# EAGLE schematic Resistor_Resistor (EAGLE 8.3.0), part 16 of 43
## Parts (continued)
R21598  10K  RESISTOR_0201  [0201]
R21599  10K  RESISTOR_0201  [0201]
R21600  10K  RESISTOR_0201  [0201]
R21601  10K  RESISTOR_0201  [0201]
R21602  10K  RESISTOR_0201  [0201]
R21603  10K  RESISTOR_0201  [0201]
R21604  10K  RESISTOR_0201  [0201]
R21605  10K  RESISTOR_0201  [0201]
R21606  10K  RESISTOR_0201  [0201]
R21607  10K  RESISTOR_0201  [0201]
R21608  10K  RESISTOR_0201  [0201]
R21609  10K  RESISTOR_0201  [0201]
R21610  10K  RESISTOR_0201  [0201]
R21611  10K  RESISTOR_0201  [0201]
R21612  10K  RESISTOR_0201  [0201]
R21613  10K  RESISTOR_0201  [0201]
R21614  10K  RESISTOR_0201  [0201]
R21615  10K  RESISTOR_0201  [0201]
R21616  10K  RESISTOR_0201  [0201]
R21617  10K  RESISTOR_0201  [0201]
R21618  10K  RESISTOR_0201  [0201]
R21619  10K  RESISTOR_0201  [0201]
R21620  10K  RESISTOR_0201  [0201]
R21621  10K  RESISTOR_0201  [0201]
R21622  10K  RESISTOR_0201  [0201]
R21623  10K  RESISTOR_0201  [0201]
R21624  10K  RESISTOR_0201  [0201]
R21625  10K  RESISTOR_0201  [0201]
R21626  10K  RESISTOR_0201  [0201]
R21627  10K  RESISTOR_0201  [0201]
R21628  10K  RESISTOR_0201  [0201]
R21629  10K  RESISTOR_0201  [0201]
R21630  10K  RESISTOR_0201  [0201]
R21631  10K  RESISTOR_0201  [0201]
R21632  10K  RESISTOR_0201  [0201]
R21633  10K  RESISTOR_0201  [0201]
R21634  10K  RESISTOR_0201  [0201]
R21635  10K  RESISTOR_0201  [0201]
R21636  10K  RESISTOR_0201  [0201]
R21637  10K  RESISTOR_0201  [0201]
R21638  10K  RESISTOR_0201  [0201]
R21639  10K  RESISTOR_0201  [0201]
R21640  10K  RESISTOR_0201  [0201]
R21641  10K  RESISTOR_0201  [0201]
R21642  10K  RESISTOR_0201  [0201]
R21643  10K  RESISTOR_0201  [0201]
R21644  10K  RESISTOR_0201  [0201]
R21645  10K  RESISTOR_0201  [0201]
R21646  10K  RESISTOR_0201  [0201]
R21647  10K  RESISTOR_0201  [0201]
R21648  10K  RESISTOR_0201  [0201]
R21649  10K  RESISTOR_0201  [0201]
R21650  10K  RESISTOR_0201  [0201]
R21651  10K  RESISTOR_0201  [0201]
R21652  10K  RESISTOR_0201  [0201]
R21653  10K  RESISTOR_0201  [0201]
R21654  10K  RESISTOR_0201  [0201]
R21655  10K  RESISTOR_0201  [0201]
R21656  10K  RESISTOR_0201  [0201]
R21657  10K  RESISTOR_0201  [0201]
R21658  10K  RESISTOR_0201  [0201]
R21659  10K  RESISTOR_0201  [0201]
R21660  10K  RESISTOR_0201  [0201]
R21661  10K  RESISTOR_0201  [0201]
R21662  10K  RESISTOR_0201  [0201]
R21663  10K  RESISTOR_0201  [0201]
R21664  10K  RESISTOR_0201  [0201]
R21665  10K  RESISTOR_0201  [0201]
R21666  10K  RESISTOR_0201  [0201]
R21667  10K  RESISTOR_0201  [0201]
R21668  10K  RESISTOR_0201  [0201]
R21669  10K  RESISTOR_0201  [0201]
R21670  10K  RESISTOR_0201  [0201]
R21671  10K  RESISTOR_0201  [0201]
R21672  10K  RESISTOR_0201  [0201]
R21673  10K  RESISTOR_0201  [0201]
R21674  10K  RESISTOR_0201  [0201]
R21675  10K  RESISTOR_0201  [0201]
R21676  10K  RESISTOR_0201  [0201]
R21677  10K  RESISTOR_0201  [0201]
R21678  10K  RESISTOR_0201  [0201]
R21679  10K  RESISTOR_0201  [0201]
R21680  10K  RESISTOR_0201  [0201]
R21681  10K  RESISTOR_0201  [0201]
R21682  10K  RESISTOR_0201  [0201]
R21683  10K  RESISTOR_0201  [0201]
R21684  10K  RESISTOR_0201  [0201]
R21685  10K  RESISTOR_0201  [0201]
R21686  10K  RESISTOR_0201  [0201]
R21687  10K  RESISTOR_0201  [0201]
R21688  10K  RESISTOR_0201  [0201]
R21689  10K  RESISTOR_0201  [0201]
R21690  10K  RESISTOR_0201  [0201]
R21691  10K  RESISTOR_0201  [0201]
R21692  10K  RESISTOR_0201  [0201]
R21693  10K  RESISTOR_0201  [0201]
R21694  10K  RESISTOR_0201  [0201]
R21695  10K  RESISTOR_0201  [0201]
R21696  10K  RESISTOR_0201  [0201]
R21697  10K  RESISTOR_0201  [0201]
R21698  10K  RESISTOR_0201  [0201]
R21699  10K  RESISTOR_0201  [0201]
R21700  10K  RESISTOR_0201  [0201]
R21701  10K  RESISTOR_0201  [0201]
R21702  10K  RESISTOR_0201  [0201]
R21703  10K  RESISTOR_0201  [0201]
R21704  10K  RESISTOR_0201  [0201]
R21705  10K  RESISTOR_0201  [0201]
R21706  10K  RESISTOR_0201  [0201]
R21707  10K  RESISTOR_0201  [0201]
R21708  10K  RESISTOR_0201  [0201]
R21709  10K  RESISTOR_0201  [0201]
R21710  10K  RESISTOR_0201  [0201]
R21711  10K  RESISTOR_0201  [0201]
R21712  10K  RESISTOR_0201  [0201]
R21713  10K  RESISTOR_0201  [0201]
R21714  10K  RESISTOR_0201  [0201]
R21715  10K  RESISTOR_0201  [0201]
R21716  10K  RESISTOR_0201  [0201]
R21717  10K  RESISTOR_0201  [0201]
R21718  10K  RESISTOR_0201  [0201]
R21719  10K  RESISTOR_0201  [0201]
R21720  10K  RESISTOR_0201  [0201]
R21721  10K  RESISTOR_0201  [0201]
R21722  10K  RESISTOR_0201  [0201]
R21723  10K  RESISTOR_0201  [0201]
R21724  10K  RESISTOR_0201  [0201]
R21725  10K  RESISTOR_0201  [0201]
R21726  10K  RESISTOR_0201  [0201]
R21727  10K  RESISTOR_0201  [0201]
R21728  10K  RESISTOR_0201  [0201]
R21729  10K  RESISTOR_0201  [0201]
R21730  10K  RESISTOR_0201  [0201]
R21731  10K  RESISTOR_0201  [0201]
R21732  10K  RESISTOR_0201  [0201]
R21733  10K  RESISTOR_0201  [0201]
R21734  10K  RESISTOR_0201  [0201]
R21735  10K  RESISTOR_0201  [0201]
R21736  10K  RESISTOR_0201  [0201]
R21737  10K  RESISTOR_0201  [0201]
R21738  10K  RESISTOR_0201  [0201]
R21739  10K  RESISTOR_0201  [0201]
R21740  10K  RESISTOR_0201  [0201]
R21741  10K  RESISTOR_0201  [0201]
R21742  10K  RESISTOR_0201  [0201]
R21743  10K  RESISTOR_0201  [0201]
R21744  10K  RESISTOR_0201  [0201]
R21745  10K  RESISTOR_0201  [0201]
R21746  10K  RESISTOR_0201  [0201]
R21747  10K  RESISTOR_0201  [0201]
R21748  10K  RESISTOR_0201  [0201]
R21749  10K  RESISTOR_0201  [0201]
R21750  10K  RESISTOR_0201  [0201]
R21751  10K  RESISTOR_0201  [0201]
R21752  10K  RESISTOR_0201  [0201]
R21753  10K  RESISTOR_0201  [0201]
R21754  10K  RESISTOR_0201  [0201]
R21755  10K  RESISTOR_0201  [0201]
R21756  10K  RESISTOR_0201  [0201]
R21757  10K  RESISTOR_0201  [0201]
R21758  10K  RESISTOR_0201  [0201]
R21759  10K  RESISTOR_0201  [0201]
R21760  10K  RESISTOR_0201  [0201]
R21761  10K  RESISTOR_0201  [0201]
R21762  10K  RESISTOR_0201  [0201]
R21763  10K  RESISTOR_0201  [0201]
R21764  10K  RESISTOR_0201  [0201]
R21765  10K  RESISTOR_0201  [0201]
R21766  10K  RESISTOR_0201  [0201]
R21767  10K  RESISTOR_0201  [0201]
R21768  10K  RESISTOR_0201  [0201]
R21769  10K  RESISTOR_0201  [0201]
R21770  10K  RESISTOR_0201  [0201]
R21771  10K  RESISTOR_0201  [0201]
R21772  10K  RESISTOR_0201  [0201]
R21773  10K  RESISTOR_0201  [0201]
R21774  10K  RESISTOR_0201  [0201]
R21775  10K  RESISTOR_0201  [0201]
R21776  10K  RESISTOR_0201  [0201]
R21777  10K  RESISTOR_0201  [0201]
R21778  10K  RESISTOR_0201  [0201]
R21779  10K  RESISTOR_0201  [0201]
R21780  10K  RESISTOR_0201  [0201]
R21781  10K  RESISTOR_0201  [0201]
R21782  10K  RESISTOR_0201  [0201]
R21783  10K  RESISTOR_0201  [0201]
R21784  10K  RESISTOR_0201  [0201]
R21785  10K  RESISTOR_0201  [0201]
R21786  10K  RESISTOR_0201  [0201]
R21787  10K  RESISTOR_0201  [0201]
R21788  10K  RESISTOR_0201  [0201]
R21789  10K  RESISTOR_0201  [0201]
R21790  10K  RESISTOR_0201  [0201]
R21791  10K  RESISTOR_0201  [0201]
R21792  10K  RESISTOR_0201  [0201]
R21793  10K  RESISTOR_0201  [0201]
R21794  10K  RESISTOR_0201  [0201]
R21795  10K  RESISTOR_0201  [0201]
R21796  10K  RESISTOR_0201  [0201]
R21797  10K  RESISTOR_0201  [0201]
R21798  10K  RESISTOR_0201  [0201]
R21799  10K  RESISTOR_0201  [0201]
R21800  10K  RESISTOR_0201  [0201]
R21801  10K  RESISTOR_0201  [0201]
R21802  10K  RESISTOR_0201  [0201]
R21803  10K  RESISTOR_0201  [0201]
R21804  10K  RESISTOR_0201  [0201]
R21805  10K  RESISTOR_0201  [0201]
R21806  10K  RESISTOR_0201  [0201]
R21807  10K  RESISTOR_0201  [0201]
R21808  10K  RESISTOR_0201  [0201]
R21809  10K  RESISTOR_0201  [0201]
R21810  10K  RESISTOR_0201  [0201]
R21811  10K  RESISTOR_0201  [0201]
R21812  10K  RESISTOR_0201  [0201]
R21813  10K  RESISTOR_0201  [0201]
R21814  10K  RESISTOR_0201  [0201]
R21815  10K  RESISTOR_0201  [0201]
R21816  10K  RESISTOR_0201  [0201]
R21817  10K  RESISTOR_0201  [0201]
R21818  10K  RESISTOR_0201  [0201]
R21819  10K  RESISTOR_0201  [0201]
R21820  10K  RESISTOR_0201  [0201]
R21821  10K  RESISTOR_0201  [0201]
R21822  10K  RESISTOR_0201  [0201]
R21823  10K  RESISTOR_0201  [0201]
R21824  10K  RESISTOR_0201  [0201]
R21825  10K  RESISTOR_0201  [0201]
R21826  10K  RESISTOR_0201  [0201]
R21827  10K  RESISTOR_0201  [0201]
R21828  10K  RESISTOR_0201  [0201]
R21829  10K  RESISTOR_0201  [0201]
R21830  10K  RESISTOR_0201  [0201]
R21831  10K  RESISTOR_0201  [0201]
R21832  10K  RESISTOR_0201  [0201]
R21833  10K  RESISTOR_0201  [0201]
R21834  10K  RESISTOR_0201  [0201]
R21835  10K  RESISTOR_0201  [0201]
R21836  10K  RESISTOR_0201  [0201]
R21837  10K  RESISTOR_0201  [0201]
R21838  10K  RESISTOR_0201  [0201]
R21839  10K  RESISTOR_0201  [0201]
R21840  10K  RESISTOR_0201  [0201]
R21841  10K  RESISTOR_0201  [0201]
R21842  10K  RESISTOR_0201  [0201]
R21843  10K  RESISTOR_0201  [0201]
R21844  10K  RESISTOR_0201  [0201]
R21845  10K  RESISTOR_0201  [0201]
R21846  10K  RESISTOR_0201  [0201]
R21847  10K  RESISTOR_0201  [0201]
R21848  10K  RESISTOR_0201  [0201]
R21849  10K  RESISTOR_0201  [0201]
R21850  10K  RESISTOR_0201  [0201]
R21851  10K  RESISTOR_0201  [0201]
R21852  10K  RESISTOR_0201  [0201]
R21853  10K  RESISTOR_0201  [0201]
R21854  10K  RESISTOR_0201  [0201]
R21855  10K  RESISTOR_0201  [0201]
R21856  10K  RESISTOR_0201  [0201]
R21857  10K  RESISTOR_0201  [0201]
R21858  10K  RESISTOR_0201  [0201]
R21859  10K  RESISTOR_0201  [0201]
R21860  10K  RESISTOR_0201  [0201]
R21861  10K  RESISTOR_0201  [0201]
R21862  10K  RESISTOR_0201  [0201]
R21863  10K  RESISTOR_0201  [0201]
R21864  10K  RESISTOR_0201  [0201]
R21865  10K  RESISTOR_0201  [0201]
R21866  10K  RESISTOR_0201  [0201]
R21867  10K  RESISTOR_0201  [0201]
R21868  10K  RESISTOR_0201  [0201]
R21869  10K  RESISTOR_0201  [0201]
R21870  10K  RESISTOR_0201  [0201]
R21871  10K  RESISTOR_0201  [0201]
R21872  10K  RESISTOR_0201  [0201]
R21873  10K  RESISTOR_0201  [0201]
R21874  10K  RESISTOR_0201  [0201]
R21875  10K  RESISTOR_0201  [0201]
R21876  10K  RESISTOR_0201  [0201]
R21877  10K  RESISTOR_0201  [0201]
R21878  10K  RESISTOR_0201  [0201]
R21879  10K  RESISTOR_0201  [0201]
R21880  10K  RESISTOR_0201  [0201]
R21881  10K  RESISTOR_0201  [0201]
R21882  10K  RESISTOR_0201  [0201]
R21883  10K  RESISTOR_0201  [0201]
R21884  10K  RESISTOR_0201  [0201]
R21885  10K  RESISTOR_0201  [0201]
R21886  10K  RESISTOR_0201  [0201]
R21887  10K  RESISTOR_0201  [0201]
R21888  10K  RESISTOR_0201  [0201]
R21889  10K  RESISTOR_0201  [0201]
R21890  10K  RESISTOR_0201  [0201]
R21891  10K  RESISTOR_0201  [0201]
R21892  10K  RESISTOR_0201  [0201]
R21893  10K  RESISTOR_0201  [0201]
R21894  10K  RESISTOR_0201  [0201]
R21895  10K  RESISTOR_0201  [0201]
R21896  10K  RESISTOR_0201  [0201]
R21897  10K  RESISTOR_0201  [0201]
R21898  10K  RESISTOR_0201  [0201]
R21899  10K  RESISTOR_0201  [0201]
R21900  10K  RESISTOR_0201  [0201]
R21901  10K  RESISTOR_0201  [0201]
R21902  10K  RESISTOR_0201  [0201]
R21903  10K  RESISTOR_0201  [0201]
R21904  10K  RESISTOR_0201  [0201]
R21905  10K  RESISTOR_0201  [0201]
R21906  10K  RESISTOR_0201  [0201]
R21907  10K  RESISTOR_0201  [0201]
R21908  10K  RESISTOR_0201  [0201]
R21909  10K  RESISTOR_0201  [0201]
R21910  10K  RESISTOR_0201  [0201]
R21911  10K  RESISTOR_0201  [0201]
R21912  10K  RESISTOR_0201  [0201]
R21913  10K  RESISTOR_0201  [0201]
R21914  10K  RESISTOR_0201  [0201]
R21915  10K  RESISTOR_0201  [0201]
R21916  10K  RESISTOR_0201  [0201]
R21917  10K  RESISTOR_0201  [0201]
R21918  10K  RESISTOR_0201  [0201]
R21919  10K  RESISTOR_0201  [0201]
R21920  10K  RESISTOR_0201  [0201]
R21921  10K  RESISTOR_0201  [0201]
R21922  10K  RESISTOR_0201  [0201]
R21923  10K  RESISTOR_0201  [0201]
R21924  10K  RESISTOR_0201  [0201]
R21925  10K  RESISTOR_0201  [0201]
R21926  10K  RESISTOR_0201  [0201]
R21927  10K  RESISTOR_0201  [0201]
R21928  10K  RESISTOR_0201  [0201]
R21929  10K  RESISTOR_0201  [0201]
R21930  10K  RESISTOR_0201  [0201]
R21931  10K  RESISTOR_0201  [0201]
R21932  10K  RESISTOR_0201  [0201]
R21933  10K  RESISTOR_0201  [0201]
R21934  10K  RESISTOR_0201  [0201]
R21935  10K  RESISTOR_0201  [0201]
R21936  10K  RESISTOR_0201  [0201]
R21937  10K  RESISTOR_0201  [0201]
R21938  10K  RESISTOR_0201  [0201]
R21939  10K  RESISTOR_0201  [0201]
R21940  10K  RESISTOR_0201  [0201]
R21941  10K  RESISTOR_0201  [0201]
R21942  10K  RESISTOR_0201  [0201]
R21943  10K  RESISTOR_0201  [0201]
R21944  10K  RESISTOR_0201  [0201]
R21945  10K  RESISTOR_0201  [0201]
R21946  10K  RESISTOR_0201  [0201]
R21947  10K  RESISTOR_0201  [0201]
R21948  10K  RESISTOR_0201  [0201]
R21949  10K  RESISTOR_0201  [0201]
R21950  10K  RESISTOR_0201  [0201]
R21951  10K  RESISTOR_0201  [0201]
R21952  10K  RESISTOR_0201  [0201]
R21953  10K  RESISTOR_0201  [0201]
R21954  10K  RESISTOR_0201  [0201]
R21955  10K  RESISTOR_0201  [0201]
R21956  10K  RESISTOR_0201  [0201]
R21957  10K  RESISTOR_0201  [0201]
R21958  10K  RESISTOR_0201  [0201]
R21959  10K  RESISTOR_0201  [0201]
R21960  10K  RESISTOR_0201  [0201]
R21961  10K  RESISTOR_0201  [0201]
R21962  10K  RESISTOR_0201  [0201]
R21963  10K  RESISTOR_0201  [0201]
R21964  10K  RESISTOR_0201  [0201]
R21965  10K  RESISTOR_0201  [0201]
R21966  10K  RESISTOR_0201  [0201]
R21967  10K  RESISTOR_0201  [0201]
R21968  10K  RESISTOR_0201  [0201]
R21969  10K  RESISTOR_0201  [0201]
R21970  10K  RESISTOR_0201  [0201]
R21971  10K  RESISTOR_0201  [0201]
R21972  10K  RESISTOR_0201  [0201]
R21973  10K  RESISTOR_0201  [0201]
R21974  10K  RESISTOR_0201  [0201]
R21975  10K  RESISTOR_0201  [0201]
R21976  10K  RESISTOR_0201  [0201]
R21977  10K  RESISTOR_0201  [0201]
R21978  10K  RESISTOR_0201  [0201]
R21979  10K  RESISTOR_0201  [0201]
R21980  10K  RESISTOR_0201  [0201]
R21981  10K  RESISTOR_0201  [0201]
R21982  10K  RESISTOR_0201  [0201]
R21983  10K  RESISTOR_0201  [0201]
R21984  10K  RESISTOR_0201  [0201]
R21985  10K  RESISTOR_0201  [0201]
R21986  10K  RESISTOR_0201  [0201]
R21987  10K  RESISTOR_0201  [0201]
R21988  10K  RESISTOR_0201  [0201]
R21989  10K  RESISTOR_0201  [0201]
R21990  10K  RESISTOR_0201  [0201]
R21991  10K  RESISTOR_0201  [0201]
R21992  10K  RESISTOR_0201  [0201]
R21993  10K  RESISTOR_0201  [0201]
R21994  10K  RESISTOR_0201  [0201]
R21995  10K  RESISTOR_0201  [0201]
R21996  10K  RESISTOR_0201  [0201]
R21997  10K  RESISTOR_0201  [0201]
R21998  10K  RESISTOR_0201  [0201]
R21999  10K  RESISTOR_0201  [0201]
R22000  10K  RESISTOR_0201  [0201]
R22001  10K  RESISTOR_0201  [0201]
R22002  10K  RESISTOR_0201  [0201]
R22003  10K  RESISTOR_0201  [0201]
R22004  10K  RESISTOR_0201  [0201]
R22005  10K  RESISTOR_0201  [0201]
R22006  10K  RESISTOR_0201  [0201]
R22007  10K  RESISTOR_0201  [0201]
R22008  10K  RESISTOR_0201  [0201]
R22009  10K  RESISTOR_0201  [0201]
R22010  10K  RESISTOR_0201  [0201]
R22011  10K  RESISTOR_0201  [0201]
R22012  10K  RESISTOR_0201  [0201]
R22013  10K  RESISTOR_0201  [0201]
R22014  10K  RESISTOR_0201  [0201]
R22015  10K  RESISTOR_0201  [0201]
R22016  10K  RESISTOR_0201  [0201]
R22017  10K  RESISTOR_0201  [0201]
R22018  10K  RESISTOR_0201  [0201]
R22019  10K  RESISTOR_0201  [0201]
R22020  10K  RESISTOR_0201  [0201]
R22021  10K  RESISTOR_0201  [0201]
R22022  10K  RESISTOR_0201  [0201]
R22023  10K  RESISTOR_0201  [0201]
R22024  10K  RESISTOR_0201  [0201]
R22025  10K  RESISTOR_0201  [0201]
R22026  10K  RESISTOR_0201  [0201]
R22027  10K  RESISTOR_0201  [0201]
R22028  10K  RESISTOR_0201  [0201]
R22029  10K  RESISTOR_0201  [0201]
R22030  10K  RESISTOR_0201  [0201]
R22031  10K  RESISTOR_0201  [0201]
R22032  10K  RESISTOR_0201  [0201]
R22033  10K  RESISTOR_0201  [0201]
R22034  10K  RESISTOR_0201  [0201]
R22035  10K  RESISTOR_0201  [0201]
R22036  10K  RESISTOR_0201  [0201]
R22037  10K  RESISTOR_0201  [0201]
R22038  10K  RESISTOR_0201  [0201]
R22039  10K  RESISTOR_0201  [0201]
R22040  10K  RESISTOR_0201  [0201]
R22041  10K  RESISTOR_0201  [0201]
R22042  10K  RESISTOR_0201  [0201]
R22043  10K  RESISTOR_0201  [0201]
R22044  10K  RESISTOR_0201  [0201]
R22045  10K  RESISTOR_0201  [0201]
R22046  10K  RESISTOR_0201  [0201]
R22047  10K  RESISTOR_0201  [0201]
R22048  10K  RESISTOR_0201  [0201]
R22049  10K  RESISTOR_0201  [0201]
R22050  10K  RESISTOR_0201  [0201]
R22051  10K  RESISTOR_0201  [0201]
R22052  10K  RESISTOR_0201  [0201]
R22053  10K  RESISTOR_0201  [0201]
R22054  10K  RESISTOR_0201  [0201]
R22055  10K  RESISTOR_0201  [0201]
R22056  10K  RESISTOR_0201  [0201]
R22057  10K  RESISTOR_0201  [0201]
R22058  10K  RESISTOR_0201  [0201]
R22059  10K  RESISTOR_0201  [0201]
R22060  10K  RESISTOR_0201  [0201]
R22061  10K  RESISTOR_0201  [0201]
R22062  10K  RESISTOR_0201  [0201]
R22063  10K  RESISTOR_0201  [0201]
R22064  10K  RESISTOR_0201  [0201]
R22065  10K  RESISTOR_0201  [0201]
R22066  10K  RESISTOR_0201  [0201]
R22067  10K  RESISTOR_0201  [0201]
R22068  10K  RESISTOR_0201  [0201]
R22069  10K  RESISTOR_0201  [0201]
R22070  10K  RESISTOR_0201  [0201]
R22071  10K  RESISTOR_0201  [0201]
R22072  10K  RESISTOR_0201  [0201]
R22073  10K  RESISTOR_0201  [0201]
R22074  10K  RESISTOR_0201  [0201]
R22075  10K  RESISTOR_0201  [0201]
R22076  10K  RESISTOR_0201  [0201]
R22077  10K  RESISTOR_0201  [0201]
R22078  10K  RESISTOR_0201  [0201]
R22079  10K  RESISTOR_0201  [0201]
R22080  10K  RESISTOR_0201  [0201]
R22081  10K  RESISTOR_0201  [0201]
R22082  10K  RESISTOR_0201  [0201]
R22083  10K  RESISTOR_0201  [0201]
R22084  10K  RESISTOR_0201  [0201]
R22085  10K  RESISTOR_0201  [0201]
R22086  10K  RESISTOR_0201  [0201]
R22087  10K  RESISTOR_0201  [0201]
R22088  10K  RESISTOR_0201  [0201]
R22089  10K  RESISTOR_0201  [0201]
R22090  10K  RESISTOR_0201  [0201]
R22091  10K  RESISTOR_0201  [0201]
R22092  10K  RESISTOR_0201  [0201]
R22093  10K  RESISTOR_0201  [0201]
R22094  10K  RESISTOR_0201  [0201]
R22095  10K  RESISTOR_0201  [0201]
R22096  10K  RESISTOR_0201  [0201]
R22097  10K  RESISTOR_0201  [0201]
R22098  10K  RESISTOR_0201  [0201]
R22099  10K  RESISTOR_0201  [0201]
R22100  10K  RESISTOR_0201  [0201]
R22101  10K  RESISTOR_0201  [0201]
R22102  10K  RESISTOR_0201  [0201]
R22103  10K  RESISTOR_0201  [0201]
R22104  10K  RESISTOR_0201  [0201]
R22105  10K  RESISTOR_0201  [0201]
R22106  10K  RESISTOR_0201  [0201]
R22107  10K  RESISTOR_0201  [0201]
R22108  10K  RESISTOR_0201  [0201]
R22109  10K  RESISTOR_0201  [0201]
R22110  10K  RESISTOR_0201  [0201]
R22111  10K  RESISTOR_0201  [0201]
R22112  10K  RESISTOR_0201  [0201]
R22113  10K  RESISTOR_0201  [0201]
R22114  10K  RESISTOR_0201  [0201]
R22115  10K  RESISTOR_0201  [0201]
R22116  10K  RESISTOR_0201  [0201]
R22117  10K  RESISTOR_0201  [0201]
R22118  10K  RESISTOR_0201  [0201]
R22119  10K  RESISTOR_0201  [0201]
R22120  10K  RESISTOR_0201  [0201]
R22121  10K  RESISTOR_0201  [0201]
R22122  10K  RESISTOR_0201  [0201]
R22123  10K  RESISTOR_0201  [0201]
R22124  10K  RESISTOR_0201  [0201]
R22125  10K  RESISTOR_0201  [0201]
R22126  10K  RESISTOR_0201  [0201]
R22127  10K  RESISTOR_0201  [0201]
R22128  10K  RESISTOR_0201  [0201]
R22129  10K  RESISTOR_0201  [0201]
R22130  10K  RESISTOR_0201  [0201]
R22131  10K  RESISTOR_0201  [0201]
R22132  10K  RESISTOR_0201  [0201]
R22133  10K  RESISTOR_0201  [0201]
R22134  10K  RESISTOR_0201  [0201]
R22135  10K  RESISTOR_0201  [0201]
R22136  10K  RESISTOR_0201  [0201]
R22137  10K  RESISTOR_0201  [0201]
R22138  10K  RESISTOR_0201  [0201]
R22139  10K  RESISTOR_0201  [0201]
R22140  10K  RESISTOR_0201  [0201]
R22141  10K  RESISTOR_0201  [0201]
R22142  10K  RESISTOR_0201  [0201]
R22143  10K  RESISTOR_0201  [0201]
R22144  10K  RESISTOR_0201  [0201]
R22145  10K  RESISTOR_0201  [0201]
R22146  10K  RESISTOR_0201  [0201]
R22147  10K  RESISTOR_0201  [0201]
R22148  10K  RESISTOR_0201  [0201]
R22149  10K  RESISTOR_0201  [0201]
R22150  10K  RESISTOR_0201  [0201]
R22151  10K  RESISTOR_0201  [0201]
R22152  10K  RESISTOR_0201  [0201]
R22153  10K  RESISTOR_0201  [0201]
R22154  10K  RESISTOR_0201  [0201]
R22155  10K  RESISTOR_0201  [0201]
R22156  10K  RESISTOR_0201  [0201]
R22157  10K  RESISTOR_0201  [0201]
R22158  10K  RESISTOR_0201  [0201]
R22159  10K  RESISTOR_0201  [0201]
R22160  10K  RESISTOR_0201  [0201]
R22161  10K  RESISTOR_0201  [0201]
R22162  10K  RESISTOR_0201  [0201]
R22163  10K  RESISTOR_0201  [0201]
R22164  10K  RESISTOR_0201  [0201]
R22165  10K  RESISTOR_0201  [0201]
R22166  10K  RESISTOR_0201  [0201]
R22167  10K  RESISTOR_0201  [0201]
R22168  10K  RESISTOR_0201  [0201]
R22169  10K  RESISTOR_0201  [0201]
R22170  10K  RESISTOR_0201  [0201]
R22171  10K  RESISTOR_0201  [0201]
R22172  10K  RESISTOR_0201  [0201]
R22173  10K  RESISTOR_0201  [0201]
R22174  10K  RESISTOR_0201  [0201]
R22175  10K  RESISTOR_0201  [0201]
R22176  10K  RESISTOR_0201  [0201]
R22177  10K  RESISTOR_0201  [0201]
R22178  10K  RESISTOR_0201  [0201]
R22179  10K  RESISTOR_0201  [0201]
R22180  10K  RESISTOR_0201  [0201]
R22181  10K  RESISTOR_0201  [0201]
R22182  10K  RESISTOR_0201  [0201]
R22183  10K  RESISTOR_0201  [0201]
R22184  10K  RESISTOR_0201  [0201]
R22185  10K  RESISTOR_0201  [0201]
R22186  10K  RESISTOR_0201  [0201]
R22187  10K  RESISTOR_0201  [0201]
R22188  10K  RESISTOR_0201  [0201]
R22189  10K  RESISTOR_0201  [0201]
R22190  10K  RESISTOR_0201  [0201]
R22191  10K  RESISTOR_0201  [0201]
R22192  10K  RESISTOR_0201  [0201]
R22193  10K  RESISTOR_0201  [0201]
R22194  10K  RESISTOR_0201  [0201]
R22195  10K  RESISTOR_0201  [0201]
R22196  10K  RESISTOR_0201  [0201]
R22197  10K  RESISTOR_0201  [0201]
R22198  10K  RESISTOR_0201  [0201]
R22199  10K  RESISTOR_0201  [0201]
R22200  10K  RESISTOR_0201  [0201]
R22201  10K  RESISTOR_0201  [0201]
R22202  10K  RESISTOR_0201  [0201]
R22203  10K  RESISTOR_0201  [0201]
R22204  10K  RESISTOR_0201  [0201]
R22205  10K  RESISTOR_0201  [0201]
R22206  10K  RESISTOR_0201  [0201]
R22207  10K  RESISTOR_0201  [0201]
R22208  10K  RESISTOR_0201  [0201]
R22209  10K  RESISTOR_0201  [0201]
R22210  10K  RESISTOR_0201  [0201]
R22211  10K  RESISTOR_0201  [0201]
R22212  10K  RESISTOR_0201  [0201]
R22213  10K  RESISTOR_0201  [0201]
R22214  10K  RESISTOR_0201  [0201]
R22215  10K  RESISTOR_0201  [0201]
R22216  10K  RESISTOR_0201  [0201]
R22217  10K  RESISTOR_0201  [0201]
R22218  10K  RESISTOR_0201  [0201]
R22219  10K  RESISTOR_0201  [0201]
R22220  10K  RESISTOR_0201  [0201]
R22221  10K  RESISTOR_0201  [0201]
R22222  10K  RESISTOR_0201  [0201]
R22223  10K  RESISTOR_0201  [0201]
R22224  10K  RESISTOR_0201  [0201]
R22225  10K  RESISTOR_0201  [0201]
R22226  10K  RESISTOR_0201  [0201]
R22227  10K  RESISTOR_0201  [0201]
R22228  10K  RESISTOR_0201  [0201]
R22229  10K  RESISTOR_0201  [0201]
R22230  10K  RESISTOR_0201  [0201]
R22231  10K  RESISTOR_0201  [0201]
R22232  10K  RESISTOR_0201  [0201]
R22233  10K  RESISTOR_0201  [0201]
R22234  10K  RESISTOR_0201  [0201]
R22235  10K  RESISTOR_0201  [0201]
R22236  10K  RESISTOR_0201  [0201]
R22237  10K  RESISTOR_0201  [0201]
R22238  10K  RESISTOR_0201  [0201]
R22239  10K  RESISTOR_0201  [0201]
R22240  10K  RESISTOR_0201  [0201]
R22241  10K  RESISTOR_0201  [0201]
R22242  10K  RESISTOR_0201  [0201]
R22243  10K  RESISTOR_0201  [0201]
R22244  10K  RESISTOR_0201  [0201]
R22245  10K  RESISTOR_0201  [0201]
R22246  10K  RESISTOR_0201  [0201]
R22247  10K  RESISTOR_0201  [0201]
R22248  10K  RESISTOR_0201  [0201]
R22249  10K  RESISTOR_0201  [0201]
R22250  10K  RESISTOR_0201  [0201]
R22251  10K  RESISTOR_0201  [0201]
R22252  10K  RESISTOR_0201  [0201]
R22253  10K  RESISTOR_0201  [0201]
R22254  10K  RESISTOR_0201  [0201]
R22255  10K  RESISTOR_0201  [0201]
R22256  10K  RESISTOR_0201  [0201]
R22257  10K  RESISTOR_0201  [0201]
R22258  10K  RESISTOR_0201  [0201]
R22259  10K  RESISTOR_0201  [0201]
R22260  10K  RESISTOR_0201  [0201]
R22261  10K  RESISTOR_0201  [0201]
R22262  10K  RESISTOR_0201  [0201]
R22263  10K  RESISTOR_0201  [0201]
R22264  10K  RESISTOR_0201  [0201]
R22265  10K  RESISTOR_0201  [0201]
R22266  10K  RESISTOR_0201  [0201]
R22267  10K  RESISTOR_0201  [0201]
R22268  10K  RESISTOR_0201  [0201]
R22269  10K  RESISTOR_0201  [0201]
R22270  10K  RESISTOR_0201  [0201]
R22271  10K  RESISTOR_0201  [0201]
R22272  10K  RESISTOR_0201  [0201]
R22273  10K  RESISTOR_0201  [0201]
R22274  10K  RESISTOR_0201  [0201]
R22275  10K  RESISTOR_0201  [0201]
R22276  10K  RESISTOR_0201  [0201]
R22277  10K  RESISTOR_0201  [0201]
R22278  10K  RESISTOR_0201  [0201]
R22279  10K  RESISTOR_0201  [0201]
R22280  10K  RESISTOR_0201  [0201]
R22281  10K  RESISTOR_0201  [0201]
R22282  10K  RESISTOR_0201  [0201]
R22283  10K  RESISTOR_0201  [0201]
R22284  10K  RESISTOR_0201  [0201]
R22285  10K  RESISTOR_0201  [0201]
R22286  10K  RESISTOR_0201  [0201]
R22287  10K  RESISTOR_0201  [0201]
R22288  10K  RESISTOR_0201  [0201]
R22289  10K  RESISTOR_0201  [0201]
R22290  10K  RESISTOR_0201  [0201]
R22291  10K  RESISTOR_0201  [0201]
R22292  10K  RESISTOR_0201  [0201]
R22293  10K  RESISTOR_0201  [0201]
R22294  10K  RESISTOR_0201  [0201]
R22295  10K  RESISTOR_0201  [0201]
R22296  10K  RESISTOR_0201  [0201]
R22297  10K  RESISTOR_0201  [0201]
R22298  10K  RESISTOR_0201  [0201]
R22299  10K  RESISTOR_0201  [0201]
R22300  10K  RESISTOR_0201  [0201]
R22301  10K  RESISTOR_0201  [0201]
R22302  10K  RESISTOR_0201  [0201]
R22303  10K  RESISTOR_0201  [0201]
R22304  10K  RESISTOR_0201  [0201]
R22305  10K  RESISTOR_0201  [0201]
R22306  10K  RESISTOR_0201  [0201]
R22307  10K  RESISTOR_0201  [0201]
R22308  10K  RESISTOR_0201  [0201]
R22309  10K  RESISTOR_0201  [0201]
R22310  10K  RESISTOR_0201  [0201]
R22311  10K  RESISTOR_0201  [0201]
R22312  10K  RESISTOR_0201  [0201]
R22313  10K  RESISTOR_0201  [0201]
R22314  10K  RESISTOR_0201  [0201]
R22315  10K  RESISTOR_0201  [0201]
R22316  10K  RESISTOR_0201  [0201]
R22317  10K  RESISTOR_0201  [0201]
R22318  10K  RESISTOR_0201  [0201]
R22319  10K  RESISTOR_0201  [0201]
R22320  10K  RESISTOR_0201  [0201]
R22321  10K  RESISTOR_0201  [0201]
R22322  10K  RESISTOR_0201  [0201]
R22323  10K  RESISTOR_0201  [0201]
R22324  10K  RESISTOR_0201  [0201]
R22325  10K  RESISTOR_0201  [0201]
R22326  10K  RESISTOR_0201  [0201]
R22327  10K  RESISTOR_0201  [0201]
R22328  10K  RESISTOR_0201  [0201]
R22329  10K  RESISTOR_0201  [0201]
R22330  10K  RESISTOR_0201  [0201]
R22331  10K  RESISTOR_0201  [0201]
R22332  10K  RESISTOR_0201  [0201]
R22333  10K  RESISTOR_0201  [0201]
R22334  10K  RESISTOR_0201  [0201]
R22335  10K  RESISTOR_0201  [0201]
R22336  10K  RESISTOR_0201  [0201]
R22337  10K  RESISTOR_0201  [0201]
R22338  10K  RESISTOR_0201  [0201]
R22339  10K  RESISTOR_0201  [0201]
R22340  10K  RESISTOR_0201  [0201]
R22341  10K  RESISTOR_0201  [0201]
R22342  10K  RESISTOR_0201  [0201]
R22343  10K  RESISTOR_0201  [0201]
R22344  10K  RESISTOR_0201  [0201]
R22345  10K  RESISTOR_0201  [0201]
R22346  10K  RESISTOR_0201  [0201]
R22347  10K  RESISTOR_0201  [0201]
R22348  10K  RESISTOR_0201  [0201]
R22349  10K  RESISTOR_0201  [0201]
R22350  10K  RESISTOR_0201  [0201]
R22351  10K  RESISTOR_0201  [0201]
R22352  10K  RESISTOR_0201  [0201]
R22353  10K  RESISTOR_0201  [0201]
R22354  10K  RESISTOR_0201  [0201]
R22355  10K  RESISTOR_0201  [0201]
R22356  10K  RESISTOR_0201  [0201]
R22357  10K  RESISTOR_0201  [0201]
R22358  10K  RESISTOR_0201  [0201]
R22359  10K  RESISTOR_0201  [0201]
R22360  10K  RESISTOR_0201  [0201]
R22361  10K  RESISTOR_0201  [0201]
R22362  10K  RESISTOR_0201  [0201]
R22363  10K  RESISTOR_0201  [0201]
R22364  10K  RESISTOR_0201  [0201]
R22365  10K  RESISTOR_0201  [0201]
R22366  10K  RESISTOR_0201  [0201]
R22367  10K  RESISTOR_0201  [0201]
R22368  10K  RESISTOR_0201  [0201]
R22369  10K  RESISTOR_0201  [0201]
R22370  10K  RESISTOR_0201  [0201]
R22371  10K  RESISTOR_0201  [0201]
R22372  10K  RESISTOR_0201  [0201]
R22373  10K  RESISTOR_0201  [0201]
R22374  10K  RESISTOR_0201  [0201]
R22375  10K  RESISTOR_0201  [0201]
R22376  10K  RESISTOR_0201  [0201]
R22377  10K  RESISTOR_0201  [0201]
R22378  10K  RESISTOR_0201  [0201]
R22379  10K  RESISTOR_0201  [0201]
R22380  10K  RESISTOR_0201  [0201]
R22381  10K  RESISTOR_0201  [0201]
R22382  10K  RESISTOR_0201  [0201]
R22383  10K  RESISTOR_0201  [0201]
R22384  10K  RESISTOR_0201  [0201]
R22385  10K  RESISTOR_0201  [0201]
R22386  10K  RESISTOR_0201  [0201]
R22387  10K  RESISTOR_0201  [0201]
R22388  10K  RESISTOR_0201  [0201]
R22389  10K  RESISTOR_0201  [0201]
R22390  10K  RESISTOR_0201  [0201]
R22391  10K  RESISTOR_0201  [0201]
R22392  10K  RESISTOR_0201  [0201]
R22393  10K  RESISTOR_0201  [0201]
R22394  10K  RESISTOR_0201  [0201]
R22395  10K  RESISTOR_0201  [0201]
R22396  10K  RESISTOR_0201  [0201]
R22397  10K  RESISTOR_0201  [0201]
R22398  10K  RESISTOR_0201  [0201]
R22399  10K  RESISTOR_0201  [0201]
R22400  10K  RESISTOR_0201  [0201]
R22401  10K  RESISTOR_0201  [0201]
R22402  10K  RESISTOR_0201  [0201]
R22403  10K  RESISTOR_0201  [0201]
R22404  10K  RESISTOR_0201  [0201]
R22405  10K  RESISTOR_0201  [0201]
R22406  10K  RESISTOR_0201  [0201]
R22407  10K  RESISTOR_0201  [0201]
R22408  10K  RESISTOR_0201  [0201]
R22409  10K  RESISTOR_0201  [0201]
R22410  10K  RESISTOR_0201  [0201]
R22411  10K  RESISTOR_0201  [0201]
R22412  10K  RESISTOR_0201  [0201]
R22413  10K  RESISTOR_0201  [0201]
R22414  10K  RESISTOR_0201  [0201]
R22415  10K  RESISTOR_0201  [0201]
R22416  10K  RESISTOR_0201  [0201]
R22417  10K  RESISTOR_0201  [0201]
R22418  10K  RESISTOR_0201  [0201]
R22419  10K  RESISTOR_0201  [0201]
R22420  10K  RESISTOR_0201  [0201]
R22421  10K  RESISTOR_0201  [0201]
R22422  10K  RESISTOR_0201  [0201]
R22423  10K  RESISTOR_0201  [0201]
R22424  10K  RESISTOR_0201  [0201]
R22425  10K  RESISTOR_0201  [0201]
R22426  10K  RESISTOR_0201  [0201]
R22427  10K  RESISTOR_0201  [0201]
R22428  10K  RESISTOR_0201  [0201]
R22429  10K  RESISTOR_0201  [0201]
R22430  10K  RESISTOR_0201  [0201]
R22431  10K  RESISTOR_0201  [0201]
R22432  10K  RESISTOR_0201  [0201]
R22433  10K  RESISTOR_0201  [0201]
R22434  10K  RESISTOR_0201  [0201]
R22435  10K  RESISTOR_0201  [0201]
R22436  10K  RESISTOR_0201  [0201]
R22437  10K  RESISTOR_0201  [0201]
R22438  10K  RESISTOR_0201  [0201]
R22439  10K  RESISTOR_0201  [0201]
R22440  10K  RESISTOR_0201  [0201]
R22441  10K  RESISTOR_0201  [0201]
R22442  10K  RESISTOR_0201  [0201]
R22443  10K  RESISTOR_0201  [0201]
R22444  10K  RESISTOR_0201  [0201]
R22445  10K  RESISTOR_0201  [0201]
R22446  10K  RESISTOR_0201  [0201]
R22447  10K  RESISTOR_0201  [0201]
R22448  10K  RESISTOR_0201  [0201]
R22449  10K  RESISTOR_0201  [0201]
R22450  10K  RESISTOR_0201  [0201]
R22451  10K  RESISTOR_0201  [0201]
R22452  10K  RESISTOR_0201  [0201]
R22453  10K  RESISTOR_0201  [0201]
R22454  10K  RESISTOR_0201  [0201]
R22455  10K  RESISTOR_0201  [0201]
R22456  10K  RESISTOR_0201  [0201]
R22457  10K  RESISTOR_0201  [0201]
R22458  10K  RESISTOR_0201  [0201]
R22459  10K  RESISTOR_0201  [0201]
R22460  10K  RESISTOR_0201  [0201]
R22461  10K  RESISTOR_0201  [0201]
R22462  10K  RESISTOR_0201  [0201]
R22463  10K  RESISTOR_0201  [0201]
R22464  10K  RESISTOR_0201  [0201]
R22465  10K  RESISTOR_0201  [0201]
R22466  10K  RESISTOR_0201  [0201]
R22467  10K  RESISTOR_0201  [0201]
R22468  10K  RESISTOR_0201  [0201]
R22469  10K  RESISTOR_0201  [0201]
R22470  10K  RESISTOR_0201  [0201]
R22471  10K  RESISTOR_0201  [0201]
R22472  10K  RESISTOR_0201  [0201]
R22473  10K  RESISTOR_0201  [0201]
R22474  10K  RESISTOR_0201  [0201]
R22475  10K  RESISTOR_0201  [0201]
R22476  10K  RESISTOR_0201  [0201]
R22477  10K  RESISTOR_0201  [0201]
R22478  10K  RESISTOR_0201  [0201]
R22479  10K  RESISTOR_0201  [0201]
R22480  10K  RESISTOR_0201  [0201]
R22481  10K  RESISTOR_0201  [0201]
R22482  10K  RESISTOR_0201  [0201]
R22483  10K  RESISTOR_0201  [0201]
R22484  10K  RESISTOR_0201  [0201]
R22485  10K  RESISTOR_0201  [0201]
R22486  10K  RESISTOR_0201  [0201]
R22487  10K  RESISTOR_0201  [0201]
R22488  10K  RESISTOR_0201  [0201]
R22489  10K  RESISTOR_0201  [0201]
R22490  10K  RESISTOR_0201  [0201]
R22491  10K  RESISTOR_0201  [0201]
R22492  10K  RESISTOR_0201  [0201]
R22493  10K  RESISTOR_0201  [0201]
R22494  10K  RESISTOR_0201  [0201]
R22495  10K  RESISTOR_0201  [0201]
R22496  10K  RESISTOR_0201  [0201]
R22497  10K  RESISTOR_0201  [0201]
R22498  10K  RESISTOR_0201  [0201]
R22499  10K  RESISTOR_0201  [0201]
R22500  10K  RESISTOR_0201  [0201]
R22501  10K  RESISTOR_0201  [0201]
R22502  10K  RESISTOR_0201  [0201]
R22503  10K  RESISTOR_0201  [0201]
R22504  10K  RESISTOR_0201  [0201]
R22505  10K  RESISTOR_0201  [0201]
R22506  10K  RESISTOR_0201  [0201]
R22507  10K  RESISTOR_0201  [0201]
R22508  10K  RESISTOR_0201  [0201]
R22509  10K  RESISTOR_0201  [0201]
R22510  10K  RESISTOR_0201  [0201]
R22511  10K  RESISTOR_0201  [0201]
R22512  10K  RESISTOR_0201  [0201]
R22513  10K  RESISTOR_0201  [0201]
R22514  10K  RESISTOR_0201  [0201]
R22515  10K  RESISTOR_0201  [0201]
R22516  10K  RESISTOR_0201  [0201]
R22517  10K  RESISTOR_0201  [0201]
R22518  10K  RESISTOR_0201  [0201]
R22519  10K  RESISTOR_0201  [0201]
R22520  10K  RESISTOR_0201  [0201]
R22521  10K  RESISTOR_0201  [0201]
R22522  10K  RESISTOR_0201  [0201]
R22523  10K  RESISTOR_0201  [0201]
R22524  10K  RESISTOR_0201  [0201]
R22525  10K  RESISTOR_0201  [0201]
R22526  10K  RESISTOR_0201  [0201]
R22527  10K  RESISTOR_0201  [0201]
R22528  10K  RESISTOR_0201  [0201]
R22529  10K  RESISTOR_0201  [0201]
R22530  10K  RESISTOR_0201  [0201]
R22531  10K  RESISTOR_0201  [0201]
R22532  10K  RESISTOR_0201  [0201]
R22533  10K  RESISTOR_0201  [0201]
R22534  10K  RESISTOR_0201  [0201]
R22535  10K  RESISTOR_0201  [0201]
R22536  10K  RESISTOR_0201  [0201]
R22537  10K  RESISTOR_0201  [0201]
R22538  10K  RESISTOR_0201  [0201]
R22539  10K  RESISTOR_0201  [0201]
R22540  10K  RESISTOR_0201  [0201]
R22541  10K  RESISTOR_0201  [0201]
R22542  10K  RESISTOR_0201  [0201]
R22543  10K  RESISTOR_0201  [0201]
R22544  10K  RESISTOR_0201  [0201]
R22545  10K  RESISTOR_0201  [0201]
R22546  10K  RESISTOR_0201  [0201]
R22547  10K  RESISTOR_0201  [0201]
R22548  10K  RESISTOR_0201  [0201]
R22549  10K  RESISTOR_0201  [0201]
R22550  10K  RESISTOR_0201  [0201]
R22551  10K  RESISTOR_0201  [0201]
R22552  10K  RESISTOR_0201  [0201]
R22553  10K  RESISTOR_0201  [0201]
R22554  10K  RESISTOR_0201  [0201]
R22555  10K  RESISTOR_0201  [0201]
R22556  10K  RESISTOR_0201  [0201]
R22557  10K  RESISTOR_0201  [0201]
R22558  10K  RESISTOR_0201  [0201]
R22559  10K  RESISTOR_0201  [0201]
R22560  10K  RESISTOR_0201  [0201]
R22561  10K  RESISTOR_0201  [0201]
R22562  10K  RESISTOR_0201  [0201]
R22563  10K  RESISTOR_0201  [0201]
R22564  10K  RESISTOR_0201  [0201]
R22565  10K  RESISTOR_0201  [0201]
R22566  10K  RESISTOR_0201  [0201]
R22567  10K  RESISTOR_0201  [0201]
R22568  10K  RESISTOR_0201  [0201]
R22569  10K  RESISTOR_0201  [0201]
R22570  10K  RESISTOR_0201  [0201]
R22571  10K  RESISTOR_0201  [0201]
R22572  10K  RESISTOR_0201  [0201]
R22573  10K  RESISTOR_0201  [0201]
R22574  10K  RESISTOR_0201  [0201]
R22575  10K  RESISTOR_0201  [0201]
R22576  10K  RESISTOR_0201  [0201]
R22577  10K  RESISTOR_0201  [0201]
R22578  10K  RESISTOR_0201  [0201]
R22579  10K  RESISTOR_0201  [0201]
R22580  10K  RESISTOR_0201  [0201]
R22581  10K  RESISTOR_0201  [0201]
R22582  10K  RESISTOR_0201  [0201]
R22583  10K  RESISTOR_0201  [0201]
R22584  10K  RESISTOR_0201  [0201]
R22585  10K  RESISTOR_0201  [0201]
R22586  10K  RESISTOR_0201  [0201]
R22587  10K  RESISTOR_0201  [0201]
R22588  10K  RESISTOR_0201  [0201]
R22589  10K  RESISTOR_0201  [0201]
R22590  10K  RESISTOR_0201  [0201]
R22591  10K  RESISTOR_0201  [0201]
R22592  10K  RESISTOR_0201  [0201]
R22593  10K  RESISTOR_0201  [0201]
R22594  10K  RESISTOR_0201  [0201]
R22595  10K  RESISTOR_0201  [0201]
R22596  10K  RESISTOR_0201  [0201]
R22597  10K  RESISTOR_0201  [0201]
R22598  10K  RESISTOR_0201  [0201]
R22599  10K  RESISTOR_0201  [0201]
R22600  10K  RESISTOR_0201  [0201]
R22601  10K  RESISTOR_0201  [0201]
R22602  10K  RESISTOR_0201  [0201]
R22603  10K  RESISTOR_0201  [0201]
R22604  10K  RESISTOR_0201  [0201]
R22605  10K  RESISTOR_0201  [0201]
R22606  10K  RESISTOR_0201  [0201]
R22607  10K  RESISTOR_0201  [0201]
R22608  10K  RESISTOR_0201  [0201]
R22609  10K  RESISTOR_0201  [0201]
R22610  10K  RESISTOR_0201  [0201]
R22611  10K  RESISTOR_0201  [0201]
R22612  10K  RESISTOR_0201  [0201]
R22613  10K  RESISTOR_0201  [0201]
R22614  10K  RESISTOR_0201  [0201]
R22615  10K  RESISTOR_0201  [0201]
R22616  10K  RESISTOR_0201  [0201]
R22617  10K  RESISTOR_0201  [0201]
R22618  10K  RESISTOR_0201  [0201]
R22619  10K  RESISTOR_0201  [0201]
R22620  10K  RESISTOR_0201  [0201]
R22621  10K  RESISTOR_0201  [0201]
R22622  10K  RESISTOR_0201  [0201]
R22623  10K  RESISTOR_0201  [0201]
R22624  10K  RESISTOR_0201  [0201]
R22625  10K  RESISTOR_0201  [0201]
R22626  10K  RESISTOR_0201  [0201]
R22627  10K  RESISTOR_0201  [0201]
R22628  10K  RESISTOR_0201  [0201]
R22629  10K  RESISTOR_0201  [0201]
R22630  10K  RESISTOR_0201  [0201]
R22631  10K  RESISTOR_0201  [0201]
R22632  10K  RESISTOR_0201  [0201]
R22633  10K  RESISTOR_0201  [0201]
R22634  10K  RESISTOR_0201  [0201]
R22635  10K  RESISTOR_0201  [0201]
R22636  10K  RESISTOR_0201  [0201]
R22637  10K  RESISTOR_0201  [0201]
R22638  10K  RESISTOR_0201  [0201]
R22639  10K  RESISTOR_0201  [0201]
R22640  10K  RESISTOR_0201  [0201]
R22641  10K  RESISTOR_0201  [0201]
R22642  10K  RESISTOR_0201  [0201]
R22643  10K  RESISTOR_0201  [0201]
R22644  10K  RESISTOR_0201  [0201]
R22645  10K  RESISTOR_0201  [0201]
R22646  10K  RESISTOR_0201  [0201]
R22647  10K  RESISTOR_0201  [0201]
R22648  10K  RESISTOR_0201  [0201]
R22649  10K  RESISTOR_0201  [0201]
R22650  10K  RESISTOR_0201  [0201]
R22651  10K  RESISTOR_0201  [0201]
R22652  10K  RESISTOR_0201  [0201]
R22653  10K  RESISTOR_0201  [0201]
R22654  10K  RESISTOR_0201  [0201]
R22655  10K  RESISTOR_0201  [0201]
R22656  10K  RESISTOR_0201  [0201]
R22657  10K  RESISTOR_0201  [0201]
R22658  10K  RESISTOR_0201  [0201]
R22659  10K  RESISTOR_0201  [0201]
R22660  10K  RESISTOR_0201  [0201]
R22661  10K  RESISTOR_0201  [0201]
R22662  10K  RESISTOR_0201  [0201]
R22663  10K  RESISTOR_0201  [0201]
R22664  10K  RESISTOR_0201  [0201]
R22665  10K  RESISTOR_0201  [0201]
R22666  10K  RESISTOR_0201  [0201]
R22667  10K  RESISTOR_0201  [0201]
R22668  10K  RESISTOR_0201  [0201]
R22669  10K  RESISTOR_0201  [0201]
R22670  10K  RESISTOR_0201  [0201]
R22671  10K  RESISTOR_0201  [0201]
R22672  10K  RESISTOR_0201  [0201]
R22673  10K  RESISTOR_0201  [0201]
R22674  10K  RESISTOR_0201  [0201]
R22675  10K  RESISTOR_0201  [0201]
R22676  10K  RESISTOR_0201  [0201]
R22677  10K  RESISTOR_0201  [0201]
R22678  10K  RESISTOR_0201  [0201]
R22679  10K  RESISTOR_0201  [0201]
R22680  10K  RESISTOR_0201  [0201]
R22681  10K  RESISTOR_0201  [0201]
R22682  10K  RESISTOR_0201  [0201]
R22683  10K  RESISTOR_0201  [0201]
R22684  10K  RESISTOR_0201  [0201]
R22685  10K  RESISTOR_0201  [0201]
R22686  10K  RESISTOR_0201  [0201]
R22687  10K  RESISTOR_0201  [0201]
R22688  10K  RESISTOR_0201  [0201]
R22689  10K  RESISTOR_0201  [0201]
R22690  10K  RESISTOR_0201  [0201]
R22691  10K  RESISTOR_0201  [0201]
R22692  10K  RESISTOR_0201  [0201]
R22693  10K  RESISTOR_0201  [0201]
R22694  10K  RESISTOR_0201  [0201]
R22695  10K  RESISTOR_0201  [0201]
R22696  10K  RESISTOR_0201  [0201]
R22697  10K  RESISTOR_0201  [0201]
R22698  10K  RESISTOR_0201  [0201]
R22699  10K  RESISTOR_0201  [0201]
R22700  10K  RESISTOR_0201  [0201]
R22701  10K  RESISTOR_0201  [0201]
R22702  10K  RESISTOR_0201  [0201]
R22703  10K  RESISTOR_0201  [0201]
R22704  10K  RESISTOR_0201  [0201]
R22705  10K  RESISTOR_0201  [0201]
R22706  10K  RESISTOR_0201  [0201]
R22707  10K  RESISTOR_0201  [0201]
R22708  10K  RESISTOR_0201  [0201]
R22709  10K  RESISTOR_0201  [0201]
R22710  10K  RESISTOR_0201  [0201]
R22711  10K  RESISTOR_0201  [0201]
R22712  10K  RESISTOR_0201  [0201]
R22713  10K  RESISTOR_0201  [0201]
R22714  10K  RESISTOR_0201  [0201]
R22715  10K  RESISTOR_0201  [0201]
R22716  10K  RESISTOR_0201  [0201]
R22717  10K  RESISTOR_0201  [0201]
R22718  10K  RESISTOR_0201  [0201]
R22719  10K  RESISTOR_0201  [0201]
R22720  10K  RESISTOR_0201  [0201]
R22721  10K  RESISTOR_0201  [0201]
R22722  10K  RESISTOR_0201  [0201]
R22723  10K  RESISTOR_0201  [0201]
R22724  10K  RESISTOR_0201  [0201]
R22725  10K  RESISTOR_0201  [0201]
R22726  10K  RESISTOR_0201  [0201]
R22727  10K  RESISTOR_0201  [0201]
R22728  10K  RESISTOR_0201  [0201]
R22729  10K  RESISTOR_0201  [0201]
R22730  10K  RESISTOR_0201  [0201]
R22731  10K  RESISTOR_0201  [0201]
R22732  10K  RESISTOR_0201  [0201]
R22733  10K  RESISTOR_0201  [0201]
R22734  10K  RESISTOR_0201  [0201]
R22735  10K  RESISTOR_0201  [0201]
R22736  10K  RESISTOR_0201  [0201]
R22737  10K  RESISTOR_0201  [0201]
R22738  10K  RESISTOR_0201  [0201]
R22739  10K  RESISTOR_0201  [0201]
R22740  10K  RESISTOR_0201  [0201]
R22741  10K  RESISTOR_0201  [0201]
R22742  10K  RESISTOR_0201  [0201]
R22743  10K  RESISTOR_0201  [0201]
R22744  10K  RESISTOR_0201  [0201]
R22745  10K  RESISTOR_0201  [0201]
R22746  10K  RESISTOR_0201  [0201]
R22747  10K  RESISTOR_0201  [0201]
R22748  10K  RESISTOR_0201  [0201]
R22749  10K  RESISTOR_0201  [0201]
R22750  10K  RESISTOR_0201  [0201]
R22751  10K  RESISTOR_0201  [0201]
R22752  10K  RESISTOR_0201  [0201]
R22753  10K  RESISTOR_0201  [0201]
R22754  10K  RESISTOR_0201  [0201]
R22755  10K  RESISTOR_0201  [0201]
R22756  10K  RESISTOR_0201  [0201]
R22757  10K  RESISTOR_0201  [0201]
R22758  10K  RESISTOR_0201  [0201]
R22759  10K  RESISTOR_0201  [0201]
R22760  10K  RESISTOR_0201  [0201]
R22761  10K  RESISTOR_0201  [0201]
R22762  10K  RESISTOR_0201  [0201]
R22763  10K  RESISTOR_0201  [0201]
R22764  10K  RESISTOR_0201  [0201]
R22765  10K  RESISTOR_0201  [0201]
R22766  10K  RESISTOR_0201  [0201]
R22767  10K  RESISTOR_0201  [0201]
R22768  10K  RESISTOR_0201  [0201]
R22769  10K  RESISTOR_0201  [0201]
R22770  10K  RESISTOR_0201  [0201]
R22771  10K  RESISTOR_0201  [0201]
R22772  10K  RESISTOR_0201  [0201]
R22773  10K  RESISTOR_0201  [0201]
R22774  10K  RESISTOR_0201  [0201]
R22775  10K  RESISTOR_0201  [0201]
R22776  10K  RESISTOR_0201  [0201]
R22777  10K  RESISTOR_0201  [0201]
R22778  10K  RESISTOR_0201  [0201]
R22779  10K  RESISTOR_0201  [0201]
R22780  10K  RESISTOR_0201  [0201]
R22781  10K  RESISTOR_0201  [0201]
R22782  10K  RESISTOR_0201  [0201]
R22783  10K  RESISTOR_0201  [0201]
R22784  10K  RESISTOR_0201  [0201]
R22785  10K  RESISTOR_0201  [0201]
R22786  10K  RESISTOR_0201  [0201]
R22787  10K  RESISTOR_0201  [0201]
R22788  10K  RESISTOR_0201  [0201]
R22789  10K  RESISTOR_0201  [0201]
R22790  10K  RESISTOR_0201  [0201]
R22791  10K  RESISTOR_0201  [0201]
R22792  10K  RESISTOR_0201  [0201]
R22793  10K  RESISTOR_0201  [0201]
R22794  10K  RESISTOR_0201  [0201]
R22795  10K  RESISTOR_0201  [0201]
R22796  10K  RESISTOR_0201  [0201]
R22797  10K  RESISTOR_0201  [0201]
R22798  10K  RESISTOR_0201  [0201]
R22799  10K  RESISTOR_0201  [0201]
R22800  10K  RESISTOR_0201  [0201]
R22801  10K  RESISTOR_0201  [0201]
R22802  10K  RESISTOR_0201  [0201]
R22803  10K  RESISTOR_0201  [0201]
R22804  10K  RESISTOR_0201  [0201]
R22805  10K  RESISTOR_0201  [0201]
R22806  10K  RESISTOR_0201  [0201]
R22807  10K  RESISTOR_0201  [0201]
R22808  10K  RESISTOR_0201  [0201]
R22809  10K  RESISTOR_0201  [0201]
R22810  10K  RESISTOR_0201  [0201]
R22811  10K  RESISTOR_0201  [0201]
R22812  10K  RESISTOR_0201  [0201]
R22813  10K  RESISTOR_0201  [0201]
R22814  10K  RESISTOR_0201  [0201]
R22815  10K  RESISTOR_0201  [0201]
R22816  10K  RESISTOR_0201  [0201]
R22817  10K  RESISTOR_0201  [0201]
R22818  10K  RESISTOR_0201  [0201]
R22819  10K  RESISTOR_0201  [0201]
R22820  10K  RESISTOR_0201  [0201]
R22821  10K  RESISTOR_0201  [0201]
R22822  10K  RESISTOR_0201  [0201]
R22823  10K  RESISTOR_0201  [0201]
R22824  10K  RESISTOR_0201  [0201]
R22825  10K  RESISTOR_0201  [0201]
R22826  10K  RESISTOR_0201  [0201]
R22827  10K  RESISTOR_0201  [0201]
R22828  10K  RESISTOR_0201  [0201]
R22829  10K  RESISTOR_0201  [0201]
R22830  10K  RESISTOR_0201  [0201]
R22831  10K  RESISTOR_0201  [0201]
R22832  10K  RESISTOR_0201  [0201]
R22833  10K  RESISTOR_0201  [0201]
R22834  10K  RESISTOR_0201  [0201]
R22835  10K  RESISTOR_0201  [0201]
R22836  10K  RESISTOR_0201  [0201]
R22837  10K  RESISTOR_0201  [0201]
R22838  10K  RESISTOR_0201  [0201]
R22839  10K  RESISTOR_0201  [0201]
R22840  10K  RESISTOR_0201  [0201]
R22841  10K  RESISTOR_0201  [0201]
R22842  10K  RESISTOR_0201  [0201]
R22843  10K  RESISTOR_0201  [0201]
R22844  10K  RESISTOR_0201  [0201]
R22845  10K  RESISTOR_0201  [0201]
R22846  10K  RESISTOR_0201  [0201]
R22847  10K  RESISTOR_0201  [0201]
R22848  10K  RESISTOR_0201  [0201]
R22849  10K  RESISTOR_0201  [0201]
R22850  10K  RESISTOR_0201  [0201]
R22851  10K  RESISTOR_0201  [0201]
R22852  10K  RESISTOR_0201  [0201]
R22853  10K  RESISTOR_0201  [0201]
R22854  10K  RESISTOR_0201  [0201]
R22855  10K  RESISTOR_0201  [0201]
R22856  10K  RESISTOR_0201  [0201]
R22857  10K  RESISTOR_0201  [0201]
R22858  10K  RESISTOR_0201  [0201]
R22859  10K  RESISTOR_0201  [0201]
R22860  10K  RESISTOR_0201  [0201]
R22861  10K  RESISTOR_0201  [0201]
R22862  10K  RESISTOR_0201  [0201]
R22863  10K  RESISTOR_0201  [0201]
R22864  10K  RESISTOR_0201  [0201]
R22865  10K  RESISTOR_0201  [0201]
R22866  10K  RESISTOR_0201  [0201]
R22867  10K  RESISTOR_0201  [0201]
R22868  10K  RESISTOR_0201  [0201]
R22869  10K  RESISTOR_0201  [0201]
R22870  10K  RESISTOR_0201  [0201]
R22871  10K  RESISTOR_0201  [0201]
R22872  10K  RESISTOR_0201  [0201]
R22873  10K  RESISTOR_0201  [0201]
R22874  10K  RESISTOR_0201  [0201]
R22875  10K  RESISTOR_0201  [0201]
R22876  10K  RESISTOR_0201  [0201]
R22877  10K  RESISTOR_0201  [0201]
R22878  10K  RESISTOR_0201  [0201]
R22879  10K  RESISTOR_0201  [0201]
R22880  10K  RESISTOR_0201  [0201]
R22881  10K  RESISTOR_0201  [0201]
R22882  10K  RESISTOR_0201  [0201]
R22883  10K  RESISTOR_0201  [0201]
R22884  10K  RESISTOR_0201  [0201]
R22885  10K  RESISTOR_0201  [0201]
R22886  10K  RESISTOR_0201  [0201]
R22887  10K  RESISTOR_0201  [0201]
R22888  10K  RESISTOR_0201  [0201]
R22889  10K  RESISTOR_0201  [0201]
R22890  10K  RESISTOR_0201  [0201]
R22891  10K  RESISTOR_0201  [0201]
R22892  10K  RESISTOR_0201  [0201]
R22893  10K  RESISTOR_0201  [0201]
R22894  10K  RESISTOR_0201  [0201]
R22895  10K  RESISTOR_0201  [0201]
R22896  10K  RESISTOR_0201  [0201]
R22897  10K  RESISTOR_0201  [0201]
R22898  10K  RESISTOR_0201  [0201]
R22899  10K  RESISTOR_0201  [0201]
R22900  10K  RESISTOR_0201  [0201]
R22901  10K  RESISTOR_0201  [0201]
R22902  10K  RESISTOR_0201  [0201]
R22903  10K  RESISTOR_0201  [0201]
R22904  10K  RESISTOR_0201  [0201]
R22905  10K  RESISTOR_0201  [0201]
R22906  10K  RESISTOR_0201  [0201]
R22907  10K  RESISTOR_0201  [0201]
R22908  10K  RESISTOR_0201  [0201]
R22909  10K  RESISTOR_0201  [0201]
R22910  10K  RESISTOR_0201  [0201]
R22911  10K  RESISTOR_0201  [0201]
R22912  10K  RESISTOR_0201  [0201]
R22913  10K  RESISTOR_0201  [0201]
R22914  10K  RESISTOR_0201  [0201]
R22915  10K  RESISTOR_0201  [0201]
R22916  10K  RESISTOR_0201  [0201]
R22917  10K  RESISTOR_0201  [0201]
R22918  10K  RESISTOR_0201  [0201]
R22919  10K  RESISTOR_0201  [0201]
R22920  10K  RESISTOR_0201  [0201]
R22921  10K  RESISTOR_0201  [0201]
R22922  10K  RESISTOR_0201  [0201]
R22923  10K  RESISTOR_0201  [0201]
R22924  10K  RESISTOR_0201  [0201]
R22925  10K  RESISTOR_0201  [0201]
R22926  10K  RESISTOR_0201  [0201]
R22927  10K  RESISTOR_0201  [0201]
R22928  10K  RESISTOR_0201  [0201]
R22929  10K  RESISTOR_0201  [0201]
R22930  10K  RESISTOR_0201  [0201]
R22931  10K  RESISTOR_0201  [0201]
R22932  10K  RESISTOR_0201  [0201]
R22933  10K  RESISTOR_0201  [0201]
R22934  10K  RESISTOR_0201  [0201]
R22935  10K  RESISTOR_0201  [0201]
R22936  10K  RESISTOR_0201  [0201]
R22937  10K  RESISTOR_0201  [0201]
R22938  10K  RESISTOR_0201  [0201]
R22939  10K  RESISTOR_0201  [0201]
R22940  10K  RESISTOR_0201  [0201]
R22941  10K  RESISTOR_0201  [0201]
R22942  10K  RESISTOR_0201  [0201]
R22943  10K  RESISTOR_0201  [0201]
R22944  10K  RESISTOR_0201  [0201]
R22945  10K  RESISTOR_0201  [0201]
R22946  10K  RESISTOR_0201  [0201]
R22947  10K  RESISTOR_0201  [0201]
R22948  10K  RESISTOR_0201  [0201]
R22949  10K  RESISTOR_0201  [0201]
R22950  10K  RESISTOR_0201  [0201]
R22951  10K  RESISTOR_0201  [0201]
R22952  10K  RESISTOR_0201  [0201]
R22953  10K  RESISTOR_0201  [0201]
R22954  10K  RESISTOR_0201  [0201]
R22955  10K  RESISTOR_0201  [0201]
R22956  10K  RESISTOR_0201  [0201]
R22957  10K  RESISTOR_0201  [0201]
R22958  10K  RESISTOR_0201  [0201]
R22959  10K  RESISTOR_0201  [0201]
R22960  10K  RESISTOR_0201  [0201]
R22961  10K  RESISTOR_0201  [0201]
R22962  10K  RESISTOR_0201  [0201]
R22963  10K  RESISTOR_0201  [0201]
R22964  10K  RESISTOR_0201  [0201]
R22965  10K  RESISTOR_0201  [0201]
R22966  10K  RESISTOR_0201  [0201]
R22967  10K  RESISTOR_0201  [0201]
R22968  10K  RESISTOR_0201  [0201]
R22969  10K  RESISTOR_0201  [0201]
R22970  10K  RESISTOR_0201  [0201]
R22971  10K  RESISTOR_0201  [0201]
R22972  10K  RESISTOR_0201  [0201]
R22973  10K  RESISTOR_0201  [0201]
R22974  10K  RESISTOR_0201  [0201]
R22975  10K  RESISTOR_0201  [0201]
R22976  10K  RESISTOR_0201  [0201]
R22977  10K  RESISTOR_0201  [0201]
R22978  10K  RESISTOR_0201  [0201]
R22979  10K  RESISTOR_0201  [0201]
R22980  10K  RESISTOR_0201  [0201]
R22981  10K  RESISTOR_0201  [0201]
R22982  10K  RESISTOR_0201  [0201]
R22983  10K  RESISTOR_0201  [0201]
R22984  10K  RESISTOR_0201  [0201]
R22985  10K  RESISTOR_0201  [0201]
R22986  10K  RESISTOR_0201  [0201]
R22987  10K  RESISTOR_0201  [0201]
R22988  10K  RESISTOR_0201  [0201]
R22989  10K  RESISTOR_0201  [0201]
R22990  10K  RESISTOR_0201  [0201]
R22991  10K  RESISTOR_0201  [0201]
R22992  10K  RESISTOR_0201  [0201]
R22993  10K  RESISTOR_0201  [0201]
R22994  10K  RESISTOR_0201  [0201]
R22995  10K  RESISTOR_0201  [0201]
R22996  10K  RESISTOR_0201  [0201]
R22997  10K  RESISTOR_0201  [0201]
R22998  10K  RESISTOR_0201  [0201]
R22999  10K  RESISTOR_0201  [0201]
R23000  10K  RESISTOR_0201  [0201]
R23001  10K  RESISTOR_0201  [0201]
R23002  10K  RESISTOR_0201  [0201]
R23003  10K  RESISTOR_0201  [0201]
R23004  10K  RESISTOR_0201  [0201]
R23005  10K  RESISTOR_0201  [0201]
R23006  10K  RESISTOR_0201  [0201]
R23007  10K  RESISTOR_0201  [0201]
R23008  10K  RESISTOR_0201  [0201]
R23009  10K  RESISTOR_0201  [0201]
R23010  10K  RESISTOR_0201  [0201]
R23011  10K  RESISTOR_0201  [0201]
R23012  10K  RESISTOR_0201  [0201]
R23013  10K  RESISTOR_0201  [0201]
R23014  10K  RESISTOR_0201  [0201]
R23015  10K  RESISTOR_0201  [0201]
R23016  10K  RESISTOR_0201  [0201]
R23017  10K  RESISTOR_0201  [0201]